# EasyEDA Pro project kuafu01_030内部老化方案.eprj, board PCB4 (continued)
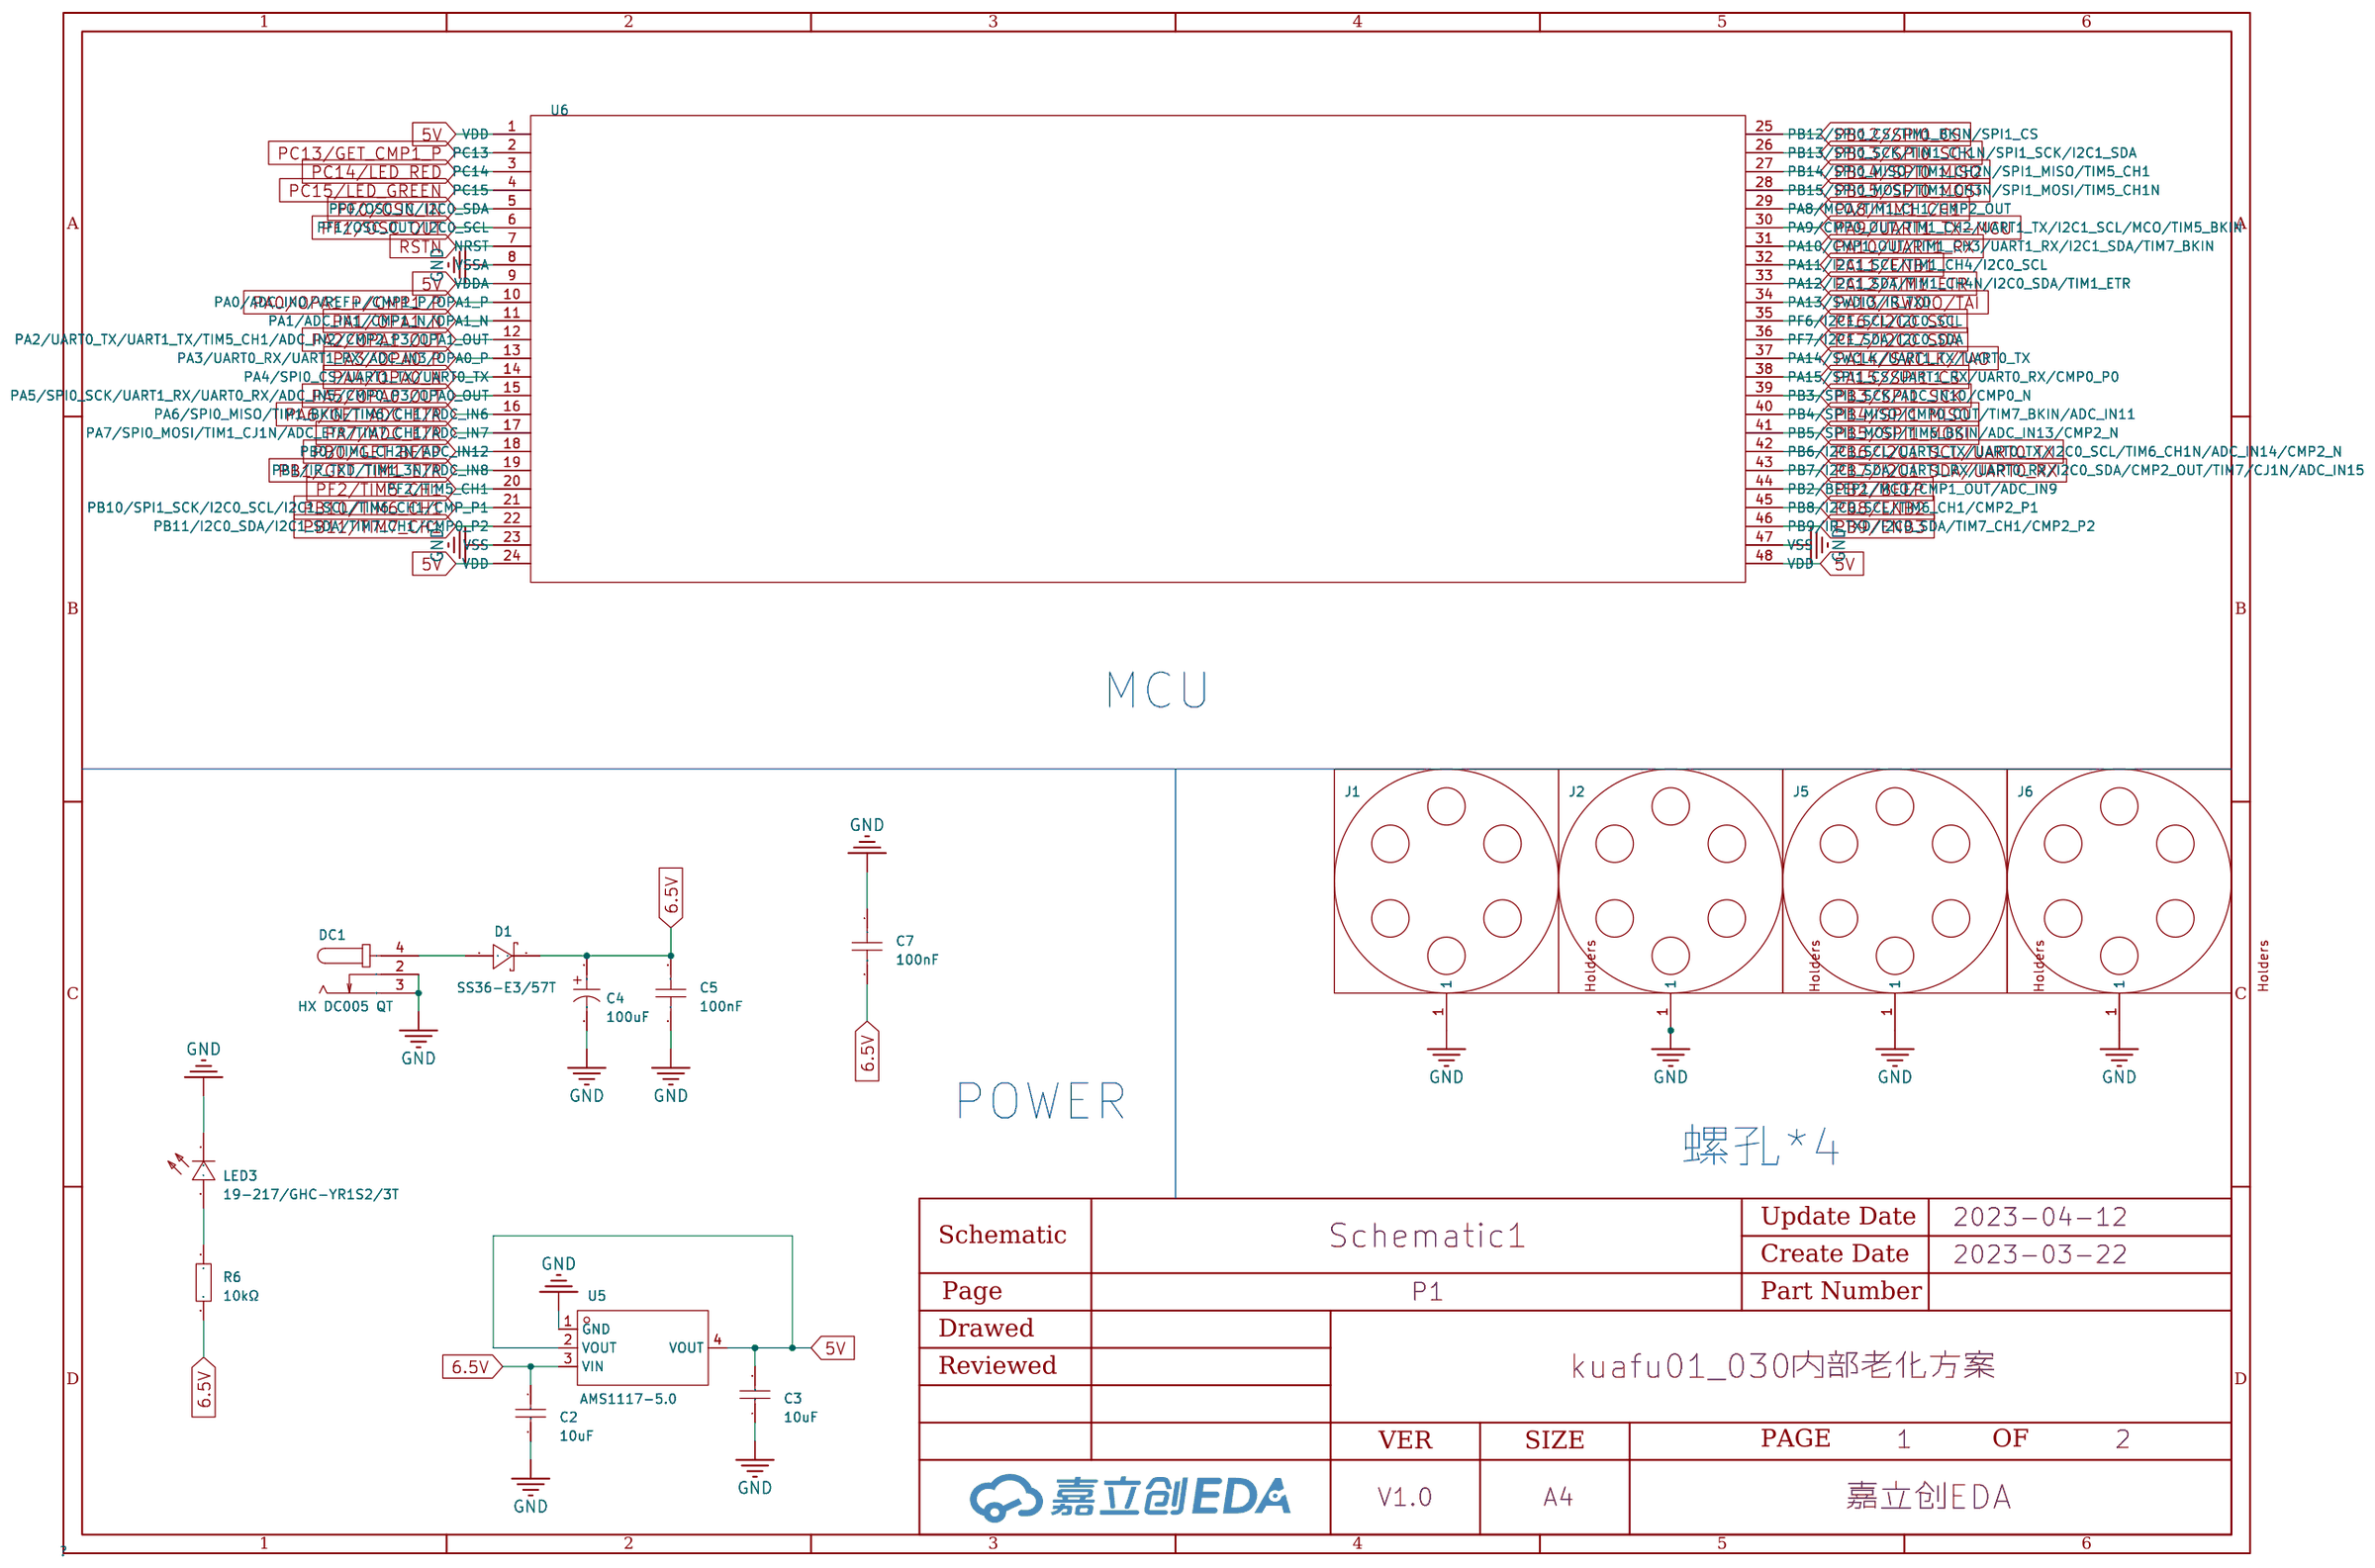
[diagram p0: P1]
## Routing (per net, layer and track width the routed paths; a pad name or vN(x,y) marks a point on that pad's centre or on a via; arc(x,y) is an arc through that point) (continued)
PB0/GET_BEEP: length 301.2
  Top Layer w0.254: R3#37.2 102.19,269.02 102.19,276.54 ; 254.59,22.54 254.59,15.02 R3#30.2 ; R3#22.2 152.99,65.82 152.99,73.34 ; 305.39,73.34 305.39,65.82 R3#25.2 ; R3#13.2 305.39,167.42 305.39,174.94 ; R3#3.2 102.19,218.22 102.19,225.74 ; R3.2 305.39,269.02 305.39,276.54 ; 51.39,22.54 51.39,15.02 R3#26.2 ; R3#36.2 51.39,269.02 51.39,276.54 ; 152.99,225.74 152.99,218.22 R3#4.2 ; R3#10.2 152.99,167.42 152.99,174.94 ; R3#23.2 203.79,65.82 203.79,73.34 ; 51.39,73.34 51.39,65.82 R3#20.2 ; R3#40.2 254.59,269.02 254.59,276.54 ; 203.79,225.74 203.79,218.22 R3#5.2 ; 51.39,225.74 51.39,218.22 R3#2.2 ; R3#11.2 203.79,167.42 203.79,174.94 ; R3#33.2 203.79,319.82 203.79,327.34 ; 102.19,327.34 102.19,319.82 R3#31.2 ; 102.19,22.54 102.19,15.02 R3#27.2 ; 305.39,225.74 305.39,218.22 R3#7.2 ; R3#8.2 51.39,167.42 51.39,174.94 ; R3#15.2 102.19,116.62 102.19,124.14 ; 254.59,124.14 254.59,116.62 R3#18.2 ; R3#39.2 203.79,269.02 203.79,276.54 ; 152.99,124.14 152.99,116.62 R3#16.2 ; R3#24.2 254.59,65.82 254.59,73.34 ; 203.79,22.54 203.79,15.02 R3#29.2 ; R3#6.2 254.59,218.22 254.59,225.74 ; 305.39,327.34 305.39,319.82 R3#35.2 ; R3#34.2 254.59,319.82 254.59,327.34 ; 254.59,174.94 254.59,167.42 R3#12.2 ; R3#17.2 203.79,116.62 203.79,124.14 ; R3#32.2 152.99,319.82 152.99,327.34 ; R3#28.2 152.99,15.02 152.99,22.54 ; R3#19.2 305.39,116.62 305.39,124.14 ; 51.39,124.14 51.39,116.62 R3#14.2 ; R3#21.2 102.19,65.82 102.19,73.34 ; R3#9.2 102.19,167.42 102.19,174.94 ; 152.99,276.54 152.99,269.02 R3#38.2
PB2/BEEP: length 2798.4
  Top Layer w0.254: 254.8,293.06 254.34,292.6 ; 254.34,292.6 254.51,292.43 254.51,288.08 254.09,287.65 254.09,285.22 ; 254.34,292.6 254.34,292.92 254.74,293.32 ; 305.14,191 305.14,191.32 305.54,191.72 ; 305.14,191 305.31,190.83 305.31,186.48 304.89,186.05 304.89,183.62 ; 305.14,191 305.6,191.46 ; v1(201.65,317.02) 201.65,319.2 202.27,319.83 ; 203.54,89.4 203.71,89.23 203.71,84.88 203.29,84.45 203.29,82.02 ; 203.54,89.4 204,89.86 ; 203.54,89.4 203.54,89.72 203.94,90.12 ; 305.14,292.6 305.31,292.43 305.31,288.08 304.89,287.65 304.89,285.22 ; 305.14,292.6 305.14,292.92 305.54,293.32 ; 305.14,292.6 305.6,293.06 ; 202.27,116.63 201.65,116 v1(201.65,113.82) ; 51.14,38.6 51.31,38.43 51.31,34.08 50.89,33.65 50.89,31.22 ; 51.14,38.6 51.6,39.06 ; 51.14,38.6 51.14,38.92 51.54,39.32 ; 102.34,293.32 101.94,292.92 101.94,292.6 ; 152.74,241.8 152.91,241.63 152.91,237.28 152.49,236.85 152.49,234.42 ; 152.74,241.8 153.2,242.26 ; 152.74,241.8 152.74,242.12 153.14,242.52 ; v1(49.25,266.22) 49.25,268.4 49.87,269.03 ; 51.14,292.6 51.14,292.92 51.54,293.32 ; 51.14,292.6 51.6,293.06 ; 51.14,292.6 51.31,292.43 51.31,288.08 50.89,287.65 50.89,285.22 ; 254.74,90.12 254.34,89.72 254.34,89.4 ; 305.6,242.26 305.14,241.8 ; 305.14,241.8 305.14,242.12 305.54,242.52 ; 305.14,241.8 305.31,241.63 305.31,237.28 304.89,236.85 304.89,234.42 ; 101.69,183.62 101.69,186.05 102.11,186.48 102.11,190.83 101.94,191 ; 203.54,292.6 203.71,292.43 203.71,288.08 203.29,287.65 203.29,285.22 ; 203.54,292.6 203.54,292.92 203.94,293.32 ; 203.54,292.6 204,293.06 ; 303.87,269.03 303.25,268.4 v1(303.25,266.22) ; v1(303.25,317.02) 303.25,319.2 303.87,319.83 ; v1(201.65,215.42) 201.65,217.6 202.27,218.23 ; 153.2,293.06 152.74,292.6 ; 152.74,292.6 152.74,292.92 153.14,293.32 ; 152.74,292.6 152.91,292.43 152.91,288.08 152.49,287.65 152.49,285.22 ; 203.54,140.2 203.54,140.52 203.94,140.92 ; 203.54,140.2 204,140.66 ; 203.54,140.2 203.71,140.03 203.71,135.68 203.29,135.25 203.29,132.82 ; 304.89,82.02 304.89,84.45 305.31,84.88 305.31,89.23 305.14,89.4 ; 254.34,140.2 254.34,140.52 254.74,140.92 ; 254.34,140.2 254.51,140.03 254.51,135.68 254.09,135.25 254.09,132.82 ; 254.34,140.2 254.8,140.66 ; 254.8,39.06 254.34,38.6 ; 254.34,38.6 254.51,38.43 254.51,34.08 254.09,33.65 254.09,31.22 ; 254.34,38.6 254.34,38.92 254.74,39.32 ; 305.54,344.12 305.14,343.72 305.14,343.4 ; 51.54,191.72 51.14,191.32 51.14,191 ; v1(150.85,63.02) 150.85,65.2 151.47,65.83 ; v1(303.25,63.02) 303.25,65.2 303.87,65.83 ; 101.69,285.22 101.69,287.65 102.11,288.08 102.11,292.43 101.94,292.6 ; v1(100.05,317.02) 100.05,319.2 100.67,319.83 ; 102.4,343.86 101.94,343.4 ; 101.94,343.4 101.94,343.72 102.34,344.12 ; 101.94,343.4 102.11,343.23 102.11,338.88 101.69,338.45 101.69,336.02 ; 305.6,89.86 305.14,89.4 ; 305.14,89.4 305.14,89.72 305.54,90.12 ; v1(252.45,215.42) 252.45,217.6 253.07,218.23 ; 51.14,140.2 51.14,140.52 51.54,140.92 ; 51.14,140.2 51.31,140.03 51.31,135.68 50.89,135.25 50.89,132.82 ; 51.14,140.2 51.6,140.66 ; 101.69,82.02 101.69,84.45 102.11,84.88 102.11,89.23 101.94,89.4 ; 102.4,89.86 101.94,89.4 ; 101.94,89.4 101.94,89.72 102.34,90.12 ; v1(150.85,164.62) 150.85,166.8 151.47,167.43 ; 51.14,191 51.31,190.83 51.31,186.48 50.89,186.05 50.89,183.62 ; 51.14,191 51.6,191.46 ; 204,343.86 203.54,343.4 ; 203.54,343.4 203.71,343.23 203.71,338.88 203.29,338.45 203.29,336.02 ; 203.54,343.4 203.54,343.72 203.94,344.12 ; 254.8,242.26 254.34,241.8 ; 254.34,241.8 254.34,242.12 254.74,242.52 ; 254.34,241.8 254.51,241.63 254.51,237.28 254.09,236.85 254.09,234.42 ; 202.27,269.03 201.65,268.4 v1(201.65,266.22) ; 152.49,183.62 152.49,186.05 152.91,186.48 152.91,190.83 152.74,191 ; 51.14,89.4 51.31,89.23 51.31,84.88 50.89,84.45 50.89,82.02 ; 51.14,89.4 51.6,89.86 ; 51.14,89.4 51.14,89.72 51.54,90.12 ; 153.2,343.86 152.74,343.4 ; 152.74,343.4 152.91,343.23 152.91,338.88 152.49,338.45 152.49,336.02 ; 152.74,343.4 152.74,343.72 153.14,344.12 ; 152.49,31.22 152.49,33.65 152.91,34.08 152.91,38.43 152.74,38.6 ; 153.14,140.92 152.74,140.52 152.74,140.2 ; 253.07,65.83 252.45,65.2 v1(252.45,63.02) ; 153.2,191.46 152.74,191 ; 152.74,191 152.74,191.32 153.14,191.72 ; 203.54,38.6 203.54,38.92 203.94,39.32 ; 203.54,38.6 203.71,38.43 203.71,34.08 203.29,33.65 203.29,31.22 ; 203.54,38.6 204,39.06 ; 254.09,82.02 254.09,84.45 254.51,84.88 254.51,89.23 254.34,89.4 ; 152.74,140.2 152.91,140.03 152.91,135.68 152.49,135.25 152.49,132.82 ; 152.74,140.2 153.2,140.66 ; 101.94,241.8 101.94,242.12 102.34,242.52 ; 101.94,241.8 102.4,242.26 ; 101.94,241.8 102.11,241.63 102.11,237.28 101.69,236.85 101.69,234.42 ; 305.14,140.2 305.14,140.52 305.54,140.92 ; 305.14,140.2 305.6,140.66 ; 305.14,140.2 305.31,140.03 305.31,135.68 304.89,135.25 304.89,132.82 ; 100.67,218.23 100.05,217.6 v1(100.05,215.42) ; v1(252.45,164.62) 252.45,166.8 253.07,167.43 ; v1(303.25,113.82) 303.25,116 303.87,116.63 ; 152.49,82.02 152.49,84.45 152.91,84.88 152.91,89.23 152.74,89.4 ; v1(100.05,63.02) 100.05,65.2 100.67,65.83 ; 102.34,140.92 101.94,140.52 101.94,140.2 ; v1(252.45,113.82) 252.45,116 253.07,116.63 ; 101.94,140.2 102.11,140.03 102.11,135.68 101.69,135.25 101.69,132.82 ; 101.94,140.2 102.4,140.66 ; 50.89,234.42 50.89,236.85 51.31,237.28 51.31,241.63 51.14,241.8 ; 253.07,15.03 252.45,14.4 v1(252.45,12.22) ; 153.14,39.32 152.74,38.92 152.74,38.6 ; 49.87,65.83 49.25,65.2 v1(49.25,63.02) ; 203.29,183.62 203.29,186.05 203.71,186.48 203.71,190.83 203.54,191 ; 102.4,39.06 101.94,38.6 ; 101.94,38.6 102.11,38.43 102.11,34.08 101.69,33.65 101.69,31.22 ; 101.94,38.6 101.94,38.92 102.34,39.32 ; 203.29,234.42 203.29,236.85 203.71,237.28 203.71,241.63 203.54,241.8 ; 254.8,191.46 254.34,191 ; 254.34,191 254.34,191.32 254.74,191.72 ; 254.34,191 254.51,190.83 254.51,186.48 254.09,186.05 254.09,183.62 ; v1(100.05,12.22) 100.05,14.4 100.67,15.03 ; 151.47,269.03 150.85,268.4 v1(150.85,266.22) ; 204,242.26 203.54,241.8 ; 203.54,241.8 203.54,242.12 203.94,242.52 ; v1(201.65,164.62) 201.65,166.8 202.27,167.43 ; 203.54,191 203.54,191.32 203.94,191.72 ; 203.54,191 204,191.46 ; 49.87,116.63 49.25,116 v1(49.25,113.82) ; 254.09,336.02 254.09,338.45 254.51,338.88 254.51,343.23 254.34,343.4 ; 305.6,343.86 305.14,343.4 ; 305.14,343.4 305.31,343.23 305.31,338.88 304.89,338.45 304.89,336.02 ; 202.27,65.83 201.65,65.2 v1(201.65,63.02) ; 151.47,15.03 150.85,14.4 v1(150.85,12.22) ; 253.07,269.03 252.45,268.4 v1(252.45,266.22) ; 101.94,292.6 102.4,293.06 ; 303.87,218.23 303.25,217.6 v1(303.25,215.42) ; 254.8,343.86 254.34,343.4 ; 254.34,343.4 254.34,343.72 254.74,344.12 ; 51.14,241.8 51.14,242.12 51.54,242.52 ; 51.14,241.8 51.6,242.26 ; v1(100.05,164.62) 100.05,166.8 100.67,167.43 ; 102.34,191.72 101.94,191.32 101.94,191 ; 153.14,90.12 152.74,89.72 152.74,89.4 ; 152.74,89.4 153.2,89.86 ; 101.94,191 102.4,191.46 ; 152.74,38.6 153.2,39.06 ; v1(100.05,266.22) 100.05,268.4 100.67,269.03 ; v1(150.85,317.02) 150.85,319.2 151.47,319.83 ; v1(49.25,12.22) 49.25,14.4 49.87,15.03 ; 49.87,167.43 49.25,166.8 v1(49.25,164.62) ; 100.67,116.63 100.05,116 v1(100.05,113.82) ; 151.47,116.63 150.85,116 v1(150.85,113.82) ; v1(201.65,12.22) 201.65,14.4 202.27,15.03 ; 151.47,218.23 150.85,217.6 v1(150.85,215.42) ; 303.87,167.43 303.25,166.8 v1(303.25,164.62) ; 49.87,218.23 49.25,217.6 v1(49.25,215.42) ; v1(252.45,317.02) 252.45,319.2 253.07,319.83 ; 254.34,89.4 254.8,89.86
  Bottom Layer w0.254: v1(203.71,240.9) 186.81,240.9 185.05,239.14 185.05,220.87 191.99,213.93 200.16,213.93 v1(201.65,215.42) ; v1(303.25,63.02) 301.76,61.53 293.59,61.53 286.65,68.47 286.65,86.74 288.41,88.5 v1(305.31,88.5) ; v1(102.1,190.1) 85.21,190.1 83.45,188.34 83.45,170.07 90.39,163.13 98.56,163.13 v1(100.05,164.62) ; v1(102.1,37.7) 85.21,37.7 83.45,35.94 83.45,17.67 90.39,10.73 98.56,10.73 v1(100.05,12.22) ; v1(254.51,240.9) 237.61,240.9 235.85,239.14 235.85,220.87 242.79,213.93 250.96,213.93 v1(252.45,215.42) ; v1(49.25,215.42) 47.76,213.93 39.59,213.93 32.65,220.87 32.65,239.14 34.41,240.9 v1(51.3,240.9) ; v1(100.05,63.02) 98.56,61.53 90.39,61.53 83.45,68.47 83.45,86.74 85.21,88.5 v1(102.1,88.5) ; v1(51.3,190.1) 34.41,190.1 32.65,188.34 32.65,170.07 39.59,163.13 47.76,163.13 v1(49.25,164.62) ; v1(254.51,291.7) 237.61,291.7 235.85,289.94 235.85,271.67 242.79,264.73 250.96,264.73 v1(252.45,266.22) ; v1(305.31,139.3) 288.41,139.3 286.65,137.54 286.65,119.27 293.59,112.33 301.76,112.33 v1(303.25,113.82) ; v1(305.31,342.5) 288.41,342.5 286.65,340.74 286.65,322.47 293.59,315.53 301.76,315.53 v1(303.25,317.02) ; v1(51.3,291.7) 34.41,291.7 32.65,289.94 32.65,271.67 39.59,264.73 47.76,264.73 v1(49.25,266.22) ; v1(203.71,291.7) 186.81,291.7 185.05,289.94 185.05,271.67 191.99,264.73 200.16,264.73 v1(201.65,266.22) ; v1(252.45,164.62) 250.96,163.13 242.79,163.13 235.85,170.07 235.85,188.34 237.61,190.1 v1(254.51,190.1) ; v1(203.71,37.7) 186.81,37.7 185.05,35.94 185.05,17.67 191.99,10.73 200.16,10.73 v1(201.65,12.22) ; v1(303.25,215.42) 301.76,213.93 293.59,213.93 286.65,220.87 286.65,239.14 288.41,240.9 v1(305.31,240.9) ; v1(152.91,342.5) 136.01,342.5 134.25,340.74 134.25,322.47 141.19,315.53 149.36,315.53 v1(150.85,317.02) ; v1(102.1,139.3) 85.21,139.3 83.45,137.54 83.45,119.27 90.39,112.33 98.56,112.33 v1(100.05,113.82) ; v1(152.91,240.9) 136.01,240.9 134.25,239.14 134.25,220.87 141.19,213.93 149.36,213.93 v1(150.85,215.42) ; v1(252.45,12.22) 250.96,10.73 242.79,10.73 235.85,17.67 235.85,35.94 237.61,37.7 v1(254.51,37.7) ; v1(152.91,139.3) 136.01,139.3 134.25,137.54 134.25,119.27 141.19,112.33 149.36,112.33 v1(150.85,113.82) ; v1(150.85,63.02) 149.36,61.53 141.19,61.53 134.25,68.47 134.25,86.74 136.01,88.5 v1(152.91,88.5) ; v1(305.31,190.1) 288.41,190.1 286.65,188.34 286.65,170.07 293.59,163.13 301.76,163.13 v1(303.25,164.62) ; v1(49.25,12.22) 47.76,10.73 39.59,10.73 32.65,17.67 32.65,35.94 34.41,37.7 v1(51.3,37.7) ; v1(152.91,291.7) 136.01,291.7 134.25,289.94 134.25,271.67 141.19,264.73 149.36,264.73 v1(150.85,266.22) ; v1(303.25,266.22) 301.76,264.73 293.59,264.73 286.65,271.67 286.65,289.94 288.41,291.7 v1(305.31,291.7) ; v1(203.71,139.3) 186.81,139.3 185.05,137.54 185.05,119.27 191.99,112.33 200.16,112.33 v1(201.65,113.82) ; v1(252.45,317.02) 250.96,315.53 242.79,315.53 235.85,322.47 235.85,340.74 237.61,342.5 v1(254.51,342.5) ; v1(152.91,37.7) 136.01,37.7 134.25,35.94 134.25,17.67 141.19,10.73 149.36,10.73 v1(150.85,12.22) ; v1(201.65,63.02) 200.16,61.53 191.99,61.53 185.05,68.47 185.05,86.74 186.81,88.5 v1(203.71,88.5) ; v1(152.91,190.1) 136.01,190.1 134.25,188.34 134.25,170.07 141.19,163.13 149.36,163.13 v1(150.85,164.62) ; v1(201.65,164.62) 200.16,163.13 191.99,163.13 185.05,170.07 185.05,188.34 186.81,190.1 v1(203.71,190.1) ; v1(102.1,291.7) 85.21,291.7 83.45,289.94 83.45,271.67 90.39,264.73 98.56,264.73 v1(100.05,266.22) ; v1(201.65,317.02) 200.16,315.53 191.99,315.53 185.05,322.47 185.05,340.74 186.81,342.5 v1(203.71,342.5) ; v1(51.3,88.5) 34.41,88.5 32.65,86.74 32.65,68.47 39.59,61.53 47.76,61.53 v1(49.25,63.02) ; v1(49.25,113.82) 47.76,112.33 39.59,112.33 32.65,119.27 32.65,137.54 34.41,139.3 v1(51.3,139.3) ; v1(254.51,139.3) 237.61,139.3 235.85,137.54 235.85,119.27 242.79,112.33 250.96,112.33 v1(252.45,113.82) ; v1(254.51,88.5) 237.61,88.5 235.85,86.74 235.85,68.47 242.79,61.53 250.96,61.53 v1(252.45,63.02) ; v1(102.1,342.5) 85.21,342.5 83.45,340.74 83.45,322.47 90.39,315.53 98.56,315.53 v1(100.05,317.02) ; v1(102.1,240.9) 85.21,240.9 83.45,239.14 83.45,220.87 90.39,213.93 98.56,213.93 v1(100.05,215.42)
PB6/I2C1_SCL/UART0_TX: length 533.4
  Top Layer w0.254: 59.2,285.5 58.69,285.5 57.79,286.4 v1(57.15,286.4) ; v1(107.95,235.6) 108.59,235.6 109.49,234.7 110,234.7 ; v1(260.35,83.2) 260.99,83.2 261.89,82.3 262.4,82.3 ; v1(260.35,32.4) 260.99,32.4 261.89,31.5 262.4,31.5 ; v1(57.15,134) 57.79,134 58.69,133.1 59.2,133.1 ; v1(158.75,83.2) 159.39,83.2 160.29,82.3 160.8,82.3 ; 110,82.3 109.49,82.3 108.59,83.2 v1(107.95,83.2) ; v1(208.02,239) 207.17,239 204.29,236.12 204.29,234.16 ; 255.09,132.56 255.09,134.52 257.97,137.4 v1(258.82,137.4) ; 153.49,132.56 153.49,134.52 156.37,137.4 v1(157.22,137.4) ; 262.4,183.9 261.89,183.9 260.99,184.8 v1(260.35,184.8) ; 204.29,284.96 204.29,286.92 207.17,289.8 v1(208.02,289.8) ; v1(258.82,239) 257.97,239 255.09,236.12 255.09,234.16 ; 51.89,81.76 51.89,83.72 54.77,86.6 v1(55.62,86.6) ; v1(208.02,340.6) 207.17,340.6 204.29,337.72 204.29,335.76 ; 255.09,335.76 255.09,337.72 257.97,340.6 v1(258.82,340.6) ; 160.8,285.5 160.29,285.5 159.39,286.4 v1(158.75,286.4) ; v1(260.35,337.2) 260.99,337.2 261.89,336.3 262.4,336.3 ; v1(309.62,137.4) 308.77,137.4 305.89,134.52 305.89,132.56 ; v1(311.15,337.2) 311.79,337.2 312.69,336.3 313.2,336.3 ; v1(55.62,137.4) 54.77,137.4 51.89,134.52 51.89,132.56 ; 204.29,183.36 204.29,185.32 207.17,188.2 v1(208.02,188.2) ; 305.89,335.76 305.89,337.72 308.77,340.6 v1(309.62,340.6) ; 160.8,133.1 160.29,133.1 159.39,134 v1(158.75,134) ; v1(311.15,286.4) 311.79,286.4 312.69,285.5 313.2,285.5 ; v1(57.15,235.6) 57.79,235.6 58.69,234.7 59.2,234.7 ; v1(57.15,184.8) 57.79,184.8 58.69,183.9 59.2,183.9 ; 153.49,335.76 153.49,337.72 156.37,340.6 v1(157.22,340.6) ; v1(209.55,83.2) 210.19,83.2 211.09,82.3 211.6,82.3 ; v1(107.95,134) 108.59,134 109.49,133.1 110,133.1 ; v1(106.42,35.8) 105.57,35.8 102.69,32.92 102.69,30.96 ; v1(106.42,188.2) 105.57,188.2 102.69,185.32 102.69,183.36 ; v1(209.55,184.8) 210.19,184.8 211.09,183.9 211.6,183.9 ; 255.09,284.96 255.09,286.92 257.97,289.8 v1(258.82,289.8) ; 110,285.5 109.49,285.5 108.59,286.4 v1(107.95,286.4) ; v1(157.22,188.2) 156.37,188.2 153.49,185.32 153.49,183.36 ; v1(55.62,188.2) 54.77,188.2 51.89,185.32 51.89,183.36 ; 305.89,284.96 305.89,286.92 308.77,289.8 v1(309.62,289.8) ; v1(158.75,235.6) 159.39,235.6 160.29,234.7 160.8,234.7 ; v1(309.62,188.2) 308.77,188.2 305.89,185.32 305.89,183.36 ; v1(157.22,289.8) 156.37,289.8 153.49,286.92 153.49,284.96 ; 110,183.9 109.49,183.9 108.59,184.8 v1(107.95,184.8) ; 255.09,81.76 255.09,83.72 257.97,86.6 v1(258.82,86.6) ; 211.6,336.3 211.09,336.3 210.19,337.2 v1(209.55,337.2) ; v1(208.02,35.8) 207.17,35.8 204.29,32.92 204.29,30.96 ; 211.6,133.1 211.09,133.1 210.19,134 v1(209.55,134) ; v1(106.42,86.6) 105.57,86.6 102.69,83.72 102.69,81.76 ; 211.6,285.5 211.09,285.5 210.19,286.4 v1(209.55,286.4) ; v1(157.22,239) 156.37,239 153.49,236.12 153.49,234.16 ; v1(107.95,337.2) 108.59,337.2 109.49,336.3 110,336.3 ; v1(258.82,188.2) 257.97,188.2 255.09,185.32 255.09,183.36 ; 211.6,31.5 211.09,31.5 210.19,32.4 v1(209.55,32.4) ; v1(208.02,137.4) 207.17,137.4 204.29,134.52 204.29,132.56 ; v1(260.35,235.6) 260.99,235.6 261.89,234.7 262.4,234.7 ; 160.8,183.9 160.29,183.9 159.39,184.8 v1(158.75,184.8) ; v1(208.02,86.6) 207.17,86.6 204.29,83.72 204.29,81.76 ; 102.69,132.56 102.69,134.52 105.57,137.4 v1(106.42,137.4) ; 160.8,31.5 160.29,31.5 159.39,32.4 v1(158.75,32.4) ; 305.89,81.76 305.89,83.72 308.77,86.6 v1(309.62,86.6) ; v1(55.62,239) 54.77,239 51.89,236.12 51.89,234.16 ; v1(57.15,83.2) 57.79,83.2 58.69,82.3 59.2,82.3 ; 102.69,234.16 102.69,236.12 105.57,239 v1(106.42,239) ; 313.2,82.3 312.69,82.3 311.79,83.2 v1(311.15,83.2) ; v1(209.55,235.6) 210.19,235.6 211.09,234.7 211.6,234.7 ; v1(55.62,35.8) 54.77,35.8 51.89,32.92 51.89,30.96 ; 255.09,30.96 255.09,32.92 257.97,35.8 v1(258.82,35.8) ; v1(158.75,337.2) 159.39,337.2 160.29,336.3 160.8,336.3 ; v1(107.95,32.4) 108.59,32.4 109.49,31.5 110,31.5 ; 51.89,284.96 51.89,286.92 54.77,289.8 v1(55.62,289.8) ; v1(311.15,184.8) 311.79,184.8 312.69,183.9 313.2,183.9 ; 305.89,234.16 305.89,236.12 308.77,239 v1(309.62,239) ; v1(157.22,35.8) 156.37,35.8 153.49,32.92 153.49,30.96 ; v1(106.42,289.8) 105.57,289.8 102.69,286.92 102.69,284.96 ; 102.69,335.76 102.69,337.72 105.57,340.6 v1(106.42,340.6) ; v1(260.35,134) 260.99,134 261.89,133.1 262.4,133.1 ; v1(311.15,134) 311.79,134 312.69,133.1 313.2,133.1 ; v1(57.15,32.4) 57.79,32.4 58.69,31.5 59.2,31.5 ; 153.49,81.76 153.49,83.72 156.37,86.6 v1(157.22,86.6) ; v1(311.15,235.6) 311.79,235.6 312.69,234.7 313.2,234.7 ; 262.4,285.5 261.89,285.5 260.99,286.4 v1(260.35,286.4)
  Bottom Layer w0.254: v1(106.42,340.6) 107.11,339.91 107.11,338.04 v1(107.95,337.2) ; v1(157.22,239) 157.91,238.31 157.91,236.44 v1(158.75,235.6) ; v1(57.15,235.6) 56.31,236.44 56.31,238.31 v1(55.62,239) ; v1(106.42,35.8) 107.11,35.11 107.11,33.24 v1(107.95,32.4) ; v1(107.95,184.8) 107.11,185.64 107.11,187.51 v1(106.42,188.2) ; v1(309.62,340.6) 310.31,339.91 310.31,338.04 v1(311.15,337.2) ; v1(260.35,32.4) 259.51,33.24 259.51,35.11 v1(258.82,35.8) ; v1(260.35,235.6) 259.51,236.44 259.51,238.31 v1(258.82,239) ; v1(57.15,32.4) 56.31,33.24 56.31,35.11 v1(55.62,35.8) ; v1(309.62,137.4) 310.31,136.71 310.31,134.84 v1(311.15,134) ; v1(157.22,35.8) 157.91,35.11 157.91,33.24 v1(158.75,32.4) ; v1(309.62,188.2) 310.31,187.51 310.31,185.64 v1(311.15,184.8) ; v1(311.15,286.4) 310.31,287.24 310.31,289.11 v1(309.62,289.8) ; v1(106.42,86.6) 107.11,85.91 107.11,84.04 v1(107.95,83.2) ; v1(260.35,83.2) 259.51,84.04 259.51,85.91 v1(258.82,86.6) ; v1(209.55,83.2) 208.71,84.04 208.71,85.91 v1(208.02,86.6) ; v1(107.95,235.6) 107.11,236.44 107.11,238.31 v1(106.42,239) ; v1(158.75,83.2) 157.91,84.04 157.91,85.91 v1(157.22,86.6) ; v1(106.42,289.8) 107.11,289.11 107.11,287.24 v1(107.95,286.4) ; v1(309.62,86.6) 310.31,85.91 310.31,84.04 v1(311.15,83.2) ; v1(209.55,134) 208.71,134.84 208.71,136.71 v1(208.02,137.4) ; v1(158.75,134) 157.91,134.84 157.91,136.71 v1(157.22,137.4) ; v1(258.82,289.8) 259.51,289.11 259.51,287.24 v1(260.35,286.4) ; v1(209.55,286.4) 208.71,287.24 208.71,289.11 v1(208.02,289.8) ; v1(106.42,137.4) 107.11,136.71 107.11,134.84 v1(107.95,134) ; v1(157.22,289.8) 157.91,289.11 157.91,287.24 v1(158.75,286.4) ; v1(208.02,239) 208.71,238.31 208.71,236.44 v1(209.55,235.6) ; v1(260.35,184.8) 259.51,185.64 259.51,187.51 v1(258.82,188.2) ; v1(55.62,188.2) 56.31,187.51 56.31,185.64 v1(57.15,184.8) ; v1(208.02,340.6) 208.71,339.91 208.71,338.04 v1(209.55,337.2) ; v1(208.02,35.8) 208.71,35.11 208.71,33.24 v1(209.55,32.4) ; v1(157.22,340.6) 157.91,339.91 157.91,338.04 v1(158.75,337.2) ; v1(57.15,134) 56.31,134.84 56.31,136.71 v1(55.62,137.4) ; v1(157.22,188.2) 157.91,187.51 157.91,185.64 v1(158.75,184.8) ; v1(57.15,286.4) 56.31,287.24 56.31,289.11 v1(55.62,289.8) ; v1(209.55,184.8) 208.71,185.64 208.71,187.51 v1(208.02,188.2) ; v1(258.82,137.4) 259.51,136.71 259.51,134.84 v1(260.35,134) ; v1(57.15,83.2) 56.31,84.04 56.31,85.91 v1(55.62,86.6) ; v1(311.15,235.6) 310.31,236.44 310.31,238.31 v1(309.62,239) ; v1(258.82,340.6) 259.51,339.91 259.51,338.04 v1(260.35,337.2)
PB7/I2C1_SDA/UART0_RX: length 838.1
  Top Layer w0.254: 204.22,345.9 205.34,344.78 205.34,340.4 ; 197.27,32.89 197.27,33.67 197.65,34.05 197.9,33.79 201.65,33.79 202.68,34.82 v1(202.68,35.6) ; 203.78,234.83 203.78,236.19 205.34,237.74 205.34,238.8 ; v1(101.08,289.6) 101.08,288.82 100.05,287.79 96.3,287.79 96.05,288.05 95.67,287.67 95.67,286.89 ; 205.34,35.6 205.34,34.54 203.78,32.99 203.78,31.63 ; 205.34,35.6 205.34,39.98 204.22,41.1 ; 205.34,35.6 205.32,35.62 v1(205.32,35.65) ; v1(154.52,137.25) 154.52,137.22 154.54,137.2 ; v1(205.32,340.45) 205.32,340.42 205.34,340.4 ; 197.27,185.29 197.27,186.07 197.65,186.45 197.9,186.19 201.65,186.19 202.68,187.22 v1(202.68,188) ; 205.34,137.2 205.32,137.22 v1(205.32,137.25) ; 205.34,137.2 205.34,136.14 203.78,134.59 203.78,133.23 ; 205.34,137.2 205.34,141.58 204.22,142.7 ; 52.94,86.4 52.92,86.42 v1(52.92,86.45) ; 52.94,86.4 52.94,90.78 51.81,91.9 ; 52.94,86.4 52.94,85.34 51.38,83.79 51.38,82.43 ; v1(202.68,340.4) 202.68,339.62 201.65,338.59 197.9,338.59 197.65,338.85 197.27,338.47 197.27,337.69 ; 305.38,82.43 305.38,83.79 306.94,85.34 306.94,86.4 ; v1(253.48,238.8) 253.48,238.02 252.45,236.99 248.7,236.99 248.45,237.25 248.07,236.87 248.07,236.09 ; 306.94,340.4 306.94,344.78 305.81,345.9 ; 306.94,340.4 306.92,340.42 v1(306.92,340.45) ; 306.94,340.4 306.94,339.34 305.38,337.79 305.38,336.43 ; 305.38,184.03 305.38,185.39 306.94,186.94 306.94,188 ; 254.58,82.43 254.58,83.79 256.14,85.34 256.14,86.4 ; 154.54,188 154.52,188.02 v1(154.52,188.05) ; 154.54,188 154.54,186.94 152.98,185.39 152.98,184.03 ; 154.54,188 154.54,192.38 153.41,193.5 ; 248.07,83.69 248.07,84.47 248.45,84.85 248.7,84.59 252.45,84.59 253.48,85.62 v1(253.48,86.4) ; 248.07,32.89 248.07,33.67 248.45,34.05 248.7,33.79 252.45,33.79 253.48,34.82 v1(253.48,35.6) ; 51.81,41.1 52.94,39.98 52.94,35.6 ; 197.27,286.89 197.27,287.67 197.65,288.05 197.9,287.79 201.65,287.79 202.68,288.82 v1(202.68,289.6) ; 306.94,188 306.94,192.38 305.81,193.5 ; 306.94,188 306.92,188.02 v1(306.92,188.05) ; 152.98,133.23 152.98,134.59 154.54,136.14 154.54,137.2 ; 102.18,184.03 102.18,185.39 103.74,186.94 103.74,188 ; 51.38,184.03 51.38,185.39 52.94,186.94 52.94,188 ; 153.41,345.9 154.54,344.78 154.54,340.4 ; 256.14,86.4 256.14,90.78 255.02,91.9 ; 256.14,86.4 256.12,86.42 v1(256.12,86.45) ; 102.61,295.1 103.74,293.98 103.74,289.6 ; 154.54,238.8 154.54,237.74 152.98,236.19 152.98,234.83 ; 154.54,238.8 154.52,238.82 v1(154.52,238.85) ; 154.54,238.8 154.54,243.18 153.41,244.3 ; v1(103.72,340.45) 103.72,340.42 103.74,340.4 ; 103.74,137.2 103.72,137.22 v1(103.72,137.25) ; 103.74,137.2 103.74,136.14 102.18,134.59 102.18,133.23 ; 103.74,137.2 103.74,141.58 102.61,142.7 ; 51.81,295.1 52.94,293.98 52.94,289.6 ; 203.78,184.03 203.78,185.39 205.34,186.94 205.34,188 ; 197.27,134.49 197.27,135.27 197.65,135.65 197.9,135.39 201.65,135.39 202.68,136.42 v1(202.68,137.2) ; 298.87,83.69 298.87,84.47 299.25,84.85 299.5,84.59 303.25,84.59 304.28,85.62 v1(304.28,86.4) ; v1(52.92,35.65) 52.92,35.62 52.94,35.6 ; 306.94,238.8 306.92,238.82 v1(306.92,238.85) ; 306.94,238.8 306.94,243.18 305.81,244.3 ; 306.94,238.8 306.94,237.74 305.38,236.19 305.38,234.83 ; v1(205.32,86.45) 205.32,86.42 205.34,86.4 ; v1(151.88,35.6) 151.88,34.82 150.85,33.79 147.1,33.79 146.85,34.05 146.47,33.67 146.47,32.89 ; 255.02,41.1 256.14,39.98 256.14,35.6 ; 205.34,289.6 205.34,293.98 204.22,295.1 ; 205.34,289.6 205.32,289.62 v1(205.32,289.65) ; 205.34,289.6 205.34,288.54 203.78,286.99 203.78,285.63 ; v1(52.92,289.65) 52.92,289.62 52.94,289.6 ; v1(151.88,188) 151.88,187.22 150.85,186.19 147.1,186.19 146.85,186.45 146.47,186.07 146.47,185.29 ; 154.54,340.4 154.54,339.34 152.98,337.79 152.98,336.43 ; 154.54,340.4 154.52,340.42 v1(154.52,340.45) ; 255.02,244.3 256.14,243.18 256.14,238.8 ; 52.94,35.6 52.94,34.54 51.38,32.99 51.38,31.63 ; 103.74,238.8 103.74,243.18 102.61,244.3 ; 103.74,238.8 103.74,237.74 102.18,236.19 102.18,234.83 ; 103.74,238.8 103.72,238.82 v1(103.72,238.85) ; v1(253.48,137.2) 253.48,136.42 252.45,135.39 248.7,135.39 248.45,135.65 248.07,135.27 248.07,134.49 ; v1(306.92,289.65) 306.92,289.62 306.94,289.6 ; 256.14,137.2 256.14,141.58 255.02,142.7 ; 256.14,137.2 256.14,136.14 254.58,134.59 254.58,133.23 ; 256.14,137.2 256.12,137.22 v1(256.12,137.25) ; 102.61,193.5 103.74,192.38 103.74,188 ; 254.58,336.43 254.58,337.79 256.14,339.34 256.14,340.4 ; 205.34,86.4 205.34,90.78 204.22,91.9 ; 205.34,86.4 205.34,85.34 203.78,83.79 203.78,82.43 ; v1(154.52,289.65) 154.52,289.62 154.54,289.6 ; 95.67,236.09 95.67,236.87 96.05,237.25 96.3,236.99 100.05,236.99 101.08,238.02 v1(101.08,238.8) ; 205.34,340.4 205.34,339.34 203.78,337.79 203.78,336.43 ; 256.14,289.6 256.14,293.98 255.02,295.1 ; 256.14,289.6 256.12,289.62 v1(256.12,289.65) ; 256.14,289.6 256.14,288.54 254.58,286.99 254.58,285.63 ; 102.18,31.63 102.18,32.99 103.74,34.54 103.74,35.6 ; v1(304.28,340.4) 304.28,339.62 303.25,338.59 299.5,338.59 299.25,338.85 298.87,338.47 298.87,337.69 ; 154.54,289.6 154.54,293.98 153.41,295.1 ; 154.54,289.6 154.54,288.54 152.98,286.99 152.98,285.63 ; v1(256.12,188.05) 256.12,188.02 256.14,188 ; 103.74,35.6 103.74,39.98 102.61,41.1 ; 103.74,35.6 103.72,35.62 v1(103.72,35.65) ; 52.94,289.6 52.94,288.54 51.38,286.99 51.38,285.63 ; v1(50.28,289.6) 50.28,288.82 49.25,287.79 45.5,287.79 45.25,288.05 44.87,287.67 44.87,286.89 ; 256.14,238.8 256.14,237.74 254.58,236.19 254.58,234.83 ; 256.14,238.8 256.12,238.82 v1(256.12,238.85) ; 103.74,340.4 103.74,344.78 102.61,345.9 ; 103.74,340.4 103.74,339.34 102.18,337.79 102.18,336.43 ; 154.54,137.2 154.54,141.58 153.41,142.7 ; 154.54,35.6 154.54,34.54 152.98,32.99 152.98,31.63 ; 154.54,35.6 154.52,35.62 v1(154.52,35.65) ; 154.54,35.6 154.54,39.98 153.41,41.1 ; 52.94,238.8 52.94,243.18 51.81,244.3 ; 52.94,238.8 52.92,238.82 v1(52.92,238.85) ; 52.94,238.8 52.94,237.74 51.38,236.19 51.38,234.83 ; v1(304.28,137.2) 304.28,136.42 303.25,135.39 299.5,135.39 299.25,135.65 298.87,135.27 298.87,134.49 ; 306.94,289.6 306.94,288.54 305.38,286.99 305.38,285.63 ; 306.94,289.6 306.94,293.98 305.81,295.1 ; 306.94,137.2 306.94,136.14 305.38,134.59 305.38,133.23 ; 306.94,137.2 306.94,141.58 305.81,142.7 ; 306.94,137.2 306.92,137.22 v1(306.92,137.25) ; 298.87,236.09 298.87,236.87 299.25,237.25 299.5,236.99 303.25,236.99 304.28,238.02 v1(304.28,238.8) ; v1(253.48,340.4) 253.48,339.62 252.45,338.59 248.7,338.59 248.45,338.85 248.07,338.47 248.07,337.69 ; v1(154.52,86.45) 154.52,86.42 154.54,86.4 ; v1(103.72,289.65) 103.72,289.62 103.74,289.6 ; 204.22,244.3 205.34,243.18 205.34,238.8 ; v1(202.68,86.4) 202.68,85.62 201.65,84.59 197.9,84.59 197.65,84.85 197.27,84.47 197.27,83.69 ; v1(101.08,86.4) 101.08,85.62 100.05,84.59 96.3,84.59 96.05,84.85 95.67,84.47 95.67,83.69 ; 51.81,193.5 52.94,192.38 52.94,188 ; 298.87,185.29 298.87,186.07 299.25,186.45 299.5,186.19 303.25,186.19 304.28,187.22 v1(304.28,188) ; 306.94,86.4 306.94,90.78 305.81,91.9 ; 306.94,86.4 306.92,86.42 v1(306.92,86.45) ; v1(151.88,340.4) 151.88,339.62 150.85,338.59 147.1,338.59 146.85,338.85 146.47,338.47 146.47,337.69 ; v1(101.08,35.6) 101.08,34.82 100.05,33.79 96.3,33.79 96.05,34.05 95.67,33.67 95.67,32.89 ; 52.94,137.2 52.94,136.14 51.38,134.59 51.38,133.23 ; 52.94,137.2 52.92,137.22 v1(52.92,137.25) ; 52.94,137.2 52.94,141.58 51.81,142.7 ; 298.87,286.89 298.87,287.67 299.25,288.05 299.5,287.79 303.25,287.79 304.28,288.82 v1(304.28,289.6) ; v1(256.12,340.45) 256.12,340.42 256.14,340.4 ; v1(253.48,289.6) 253.48,288.82 252.45,287.79 248.7,287.79 248.45,288.05 248.07,287.67 248.07,286.89 ; 248.07,185.29 248.07,186.07 248.45,186.45 248.7,186.19 252.45,186.19 253.48,187.22 v1(253.48,188) ; v1(151.88,137.2) 151.88,136.42 150.85,135.39 147.1,135.39 146.85,135.65 146.47,135.27 146.47,134.49 ; v1(151.88,238.8) 151.88,238.02 150.85,236.99 147.1,236.99 146.85,237.25 146.47,236.87 146.47,236.09 ; 44.87,32.89 44.87,33.67 45.25,34.05 45.5,33.79 49.25,33.79 50.28,34.82 v1(50.28,35.6) ; 102.61,91.9 103.74,90.78 103.74,86.4 ; v1(52.92,188.05) 52.92,188.02 52.94,188 ; v1(151.88,86.4) 151.88,85.62 150.85,84.59 147.1,84.59 146.85,84.85 146.47,84.47 146.47,83.69 ; v1(50.28,188) 50.28,187.22 49.25,186.19 45.5,186.19 45.25,186.45 44.87,186.07 44.87,185.29 ; 256.14,340.4 256.14,344.78 255.02,345.9 ; 103.74,86.4 103.74,85.34 102.18,83.79 102.18,82.43 ; 103.74,86.4 103.72,86.42 v1(103.72,86.45) ; 256.14,35.6 256.14,34.54 254.58,32.99 254.58,31.63 ; 256.14,35.6 256.12,35.62 v1(256.12,35.65) ; 103.74,188 103.72,188.02 v1(103.72,188.05) ; 95.67,337.69 95.67,338.47 96.05,338.85 96.3,338.59 100.05,338.59 101.08,339.62 v1(101.08,340.4) ; v1(50.28,137.2) 50.28,136.42 49.25,135.39 45.5,135.39 45.25,135.65 44.87,135.27 44.87,134.49 ; 255.02,193.5 256.14,192.38 256.14,188 ; v1(151.88,289.6) 151.88,288.82 150.85,287.79 147.1,287.79 146.85,288.05 146.47,287.67 146.47,286.89 ; 44.87,236.09 44.87,236.87 45.25,237.25 45.5,236.99 49.25,236.99 50.28,238.02 v1(50.28,238.8) ; 205.34,188 205.34,192.38 204.22,193.5 ; 205.34,188 205.32,188.02 v1(205.32,188.05) ; 254.58,184.03 254.58,185.39 256.14,186.94 256.14,188 ; 205.34,238.8 205.32,238.82 v1(205.32,238.85) ; 152.98,82.43 152.98,83.79 154.54,85.34 154.54,86.4 ; v1(50.28,86.4) 50.28,85.62 49.25,84.59 45.5,84.59 45.25,84.85 44.87,84.47 44.87,83.69 ; 95.67,134.49 95.67,135.27 96.05,135.65 96.3,135.39 100.05,135.39 101.08,136.42 v1(101.08,137.2) ; 154.54,86.4 154.54,90.78 153.41,91.9 ; 102.18,285.63 102.18,286.99 103.74,288.54 103.74,289.6 ; 95.67,185.29 95.67,186.07 96.05,186.45 96.3,186.19 100.05,186.19 101.08,187.22 v1(101.08,188) ; 197.27,236.09 197.27,236.87 197.65,237.25 197.9,236.99 201.65,236.99 202.68,238.02 v1(202.68,238.8)